# EasyEDA Pro project Foc驱动板.eprj, schematic Schematic2 (continued)
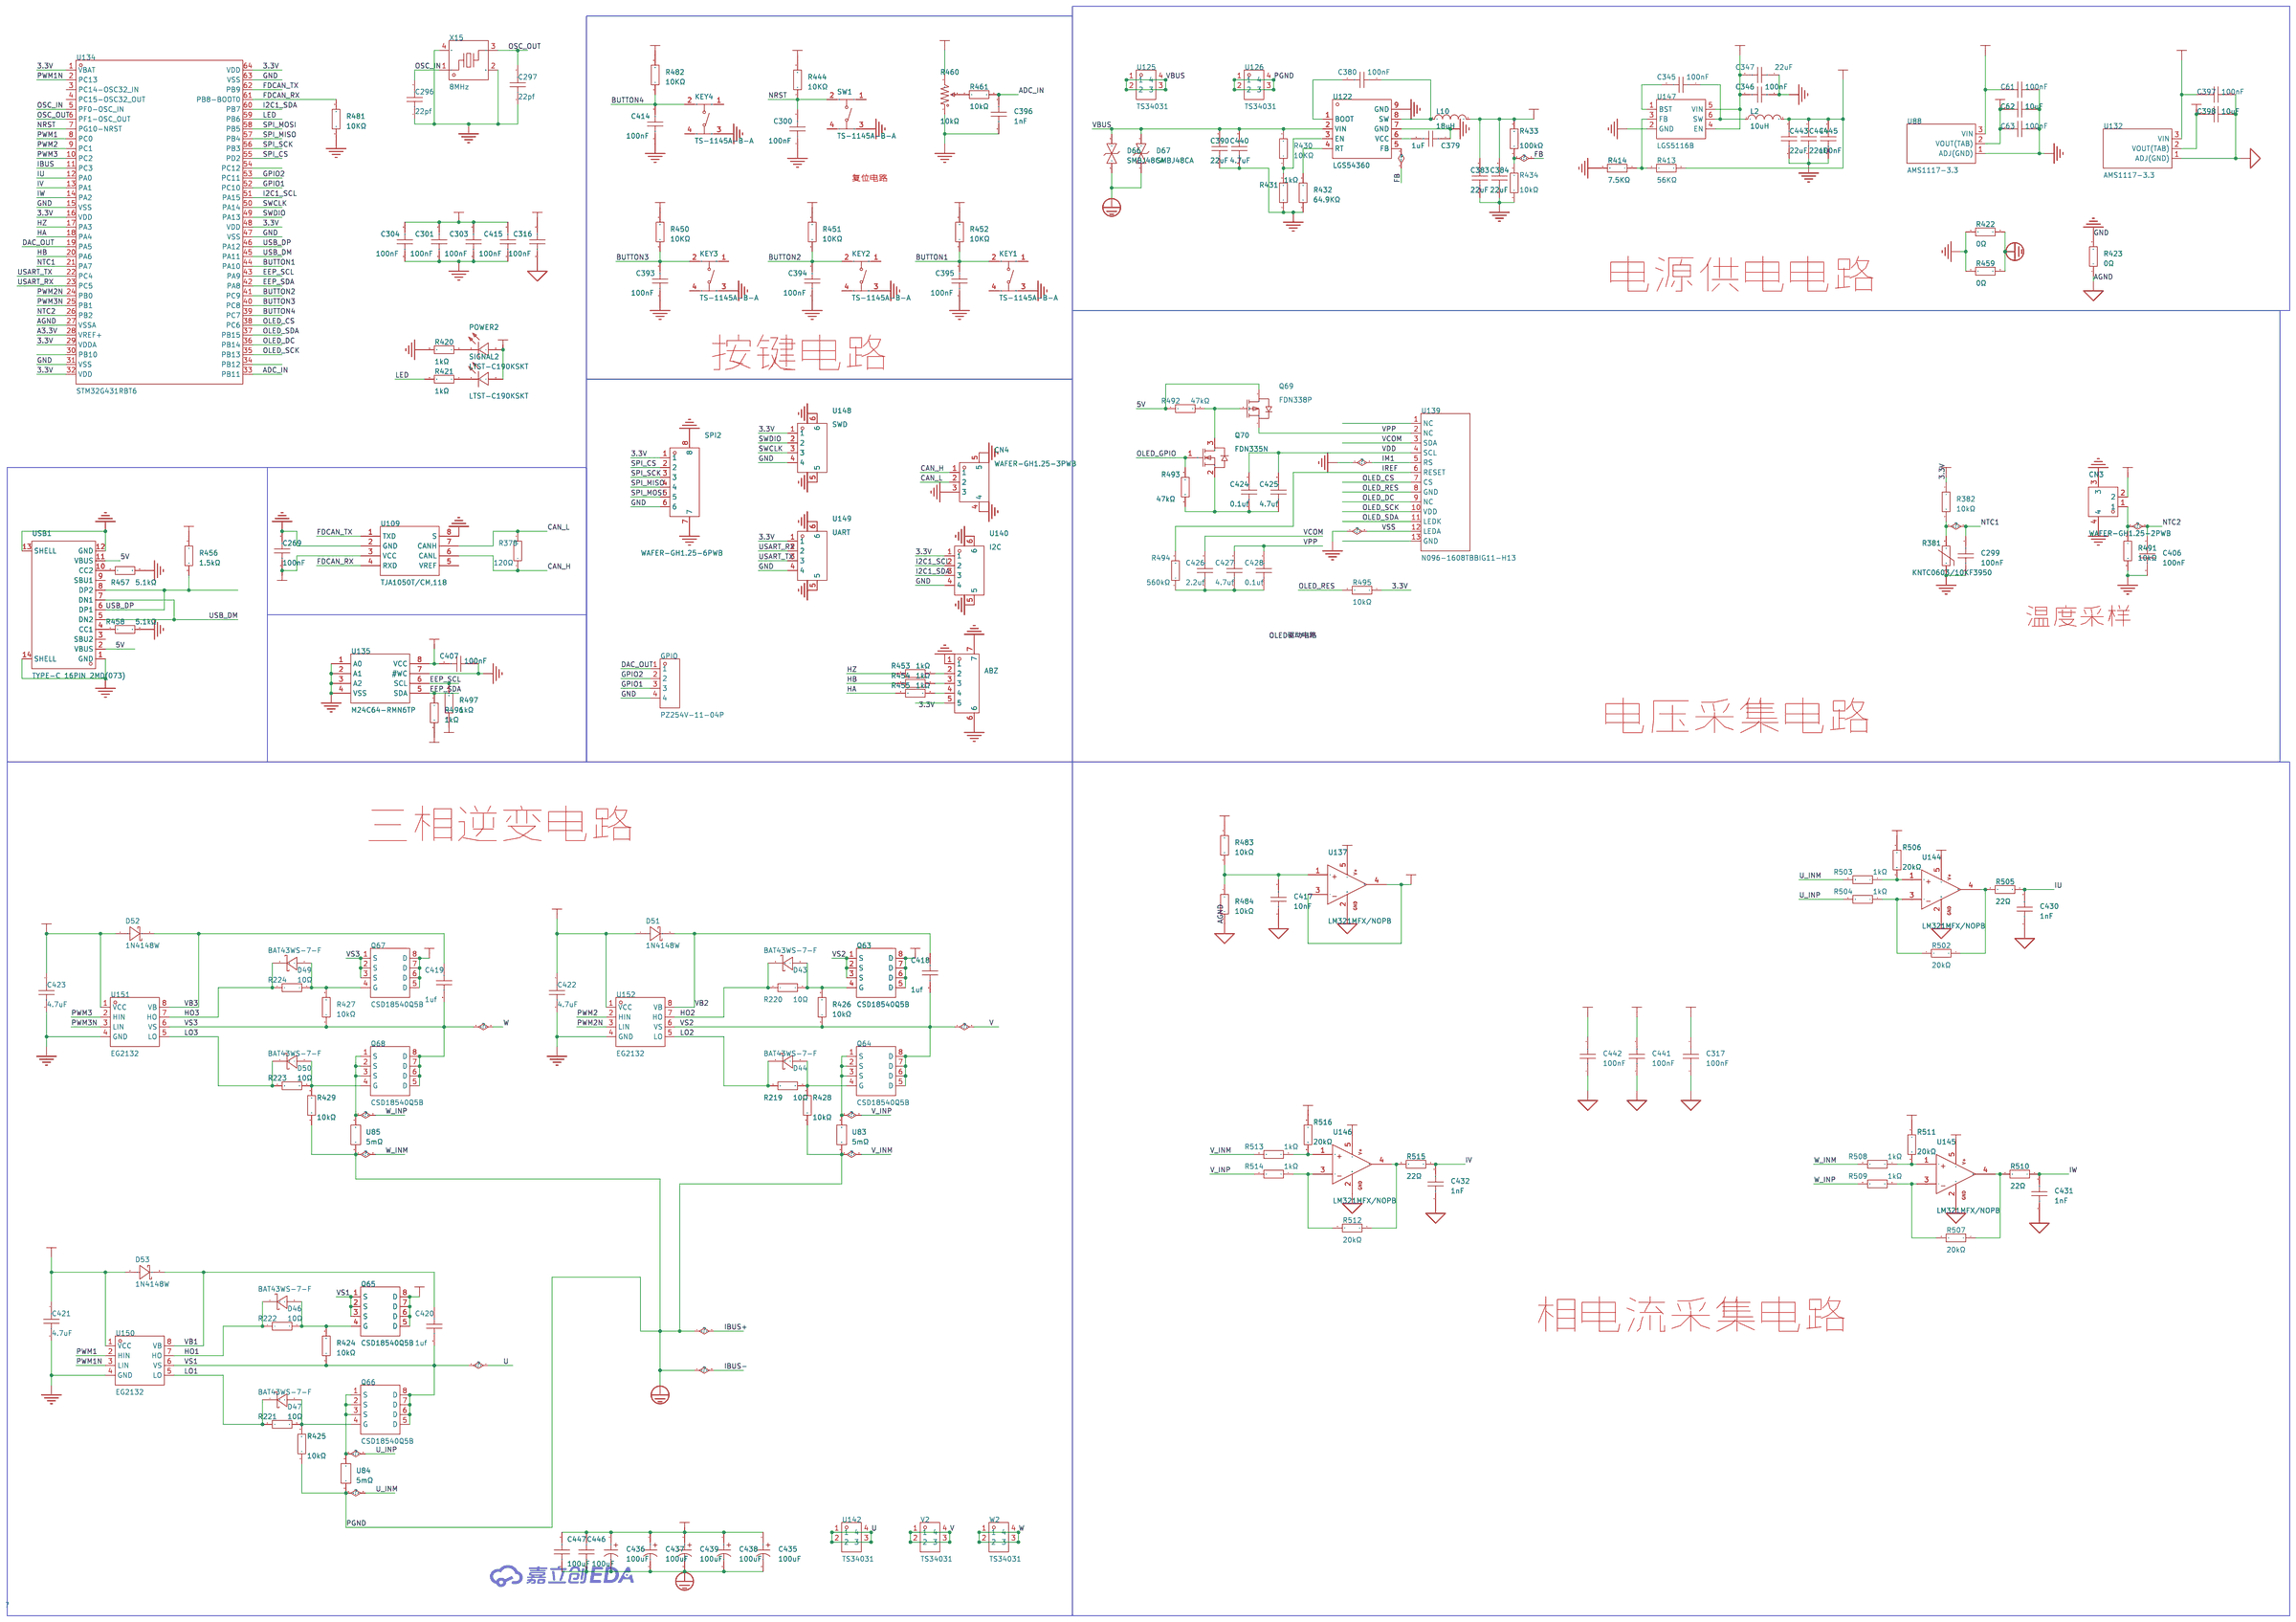
[diagram p0: schematic sheet]
## Parts
sheet MCU
C296  22pf  [C0603]
C297  22pf  [C0603]
C300  100nF  [C0603]
C301  100nF  [C0603]
C303  100nF  [C0603]
C304  100nF  [C0603]
C316  100nF  [C0603]
C415  100nF  [C0603]
POWER2  LTST-C190KSKT  [LED0603-RD]
R420  1kΩ  [R0603]
R421  1kΩ  [R0603]
R444  10KΩ  [R0603]
R481  10KΩ  [R0603]
SIGNAL2  LTST-C190KSKT  [LED0603-RD]
SW1  TS-1145A-B-A  [SW-SMD_4P-L4.2-W3.2-P2.15-LS5.2]
U134  STM32G431RBT6  [LQFP-64_L10.0-W10.0-P0.50-LS12.0-BL]
X15  8MHz  [CRYSTAL-SMD_4P-L3.2-W2.5-BL]
sheet 外设及接口电路
C269  100nF  [C0603]
C393  100nF  [C0603]
C394  100nF  [C0603]
C395  100nF  [C0603]
C396  1nF  [C0603]
C407  100nF  [C0603]
C414  100nF  [C0603]
CN5  WAFER-GH1.25-3PLB  [CONN-SMD_3P-P1.25_XUNPU_WAFER-GH1.25-3PLB]
GPIO1  PZ254V-11-04P  [HDR-TH_4P-P2.54-V-M]
KEY1  TS-1145A-B-A  [SW-SMD_4P-L4.2-W3.2-P2.15-LS5.2]
KEY2  TS-1145A-B-A  [SW-SMD_4P-L4.2-W3.2-P2.15-LS5.2]
KEY3  TS-1145A-B-A  [SW-SMD_4P-L4.2-W3.2-P2.15-LS5.2]
KEY4  TS-1145A-B-A  [SW-SMD_4P-L4.2-W3.2-P2.15-LS5.2]
R378  120Ω  [R0603]
R450  10KΩ  [R0603]
R451  10KΩ  [R0603]
R452  10KΩ  [R0603]
R453  1kΩ  [R0603]
R454  1kΩ  [R0603]
R455  1kΩ  [R0603]
R456  1.5kΩ  [R0603]
R457  5.1kΩ  [R0603]
R458  5.1kΩ  [R0603]
R460  10kΩ  [RES-ADJ-TH_3P-L9.5-W9.5-P2.54-BR-BS]
R461  10kΩ  [R0603]
R482  10KΩ  [R0603]
R496  1kΩ  [R0603]
R497  1kΩ  [R0603]
U109  TJA1050T/CM,118  [SOIC-8_L5.0-W4.0-P1.27-LS6.0-BL]
U135  M24C64-RMN6TP  [SOIC-8_L5.0-W4.0-P1.27-LS6.0-BL]
U159  WAFER-GH1.25-4PLB  [CONN-SMD_4P-P1.25_XUNPU_WAFER-GH1.25-4PLB]
U160  WAFER-GH1.25-4PLB  [CONN-SMD_4P-P1.25_XUNPU_WAFER-GH1.25-4PLB]
U161  WAFER-GH1.25-5PLB  [CONN-SMD_5P-P1.25_XUNPU_WAFER-GH1.25-5PLB]
U162  WAFER-GH1.25-6PLB  [CONN-SMD_6P-P1.25_XUNPU_WAFER-GH1.25-6PLB]
USB1  TYPE-C 16PIN 2MD(073)  [USB-C-SMD_TYPE-C-6PIN-2MD-073]
sheet 电源电路
C61  100nF  [C0603]
C62  10uF  [C0603]
C63  100nF  [C0603]
C345  100nF  [C0603]
C346  100nF  [C0603]
C347  22uF  [C0603]
C379  1uF  [C0603]
C380  100nF  [C0603]
C383  22uF  [C0805]
C384  22uF  [C0805]
C397  100nF  [C0603]
C398  10uF  [C0603]
C440  4.7uF  [C0805]
C443  22uF  [C0603]
C444  22uF  [C0603]
C445  100nF  [C0603]
C458  22uF  [CAP-SMD_BD6.3-L6.6-W6.6-LS7.4-FD]
D66  SMBJ48CA  [SMB_L4.6-W3.6-LS5.4-BI]
D67  SMBJ48CA  [SMB_L4.6-W3.6-LS5.4-BI]
L2  10uH  [IND-SMD_L5.4-W5.2_FXL0530]
L10  18uH  [IND-SMD_L6.0-W6.0]
R413  56KΩ  [R0603]
R414  7.5KΩ  [R0603]
R422  0Ω  [R0805]
R423  0Ω  [R0805]
R430  10KΩ  [R0603]
R431  1kΩ  [R0603]
R432  64.9KΩ  [R0603]
R433  100kΩ  [R0603]
R434  9.09kΩ  [R0603]
U88  AMS1117-3.3  [SOT-89_L4.5-W2.5-P1.50-LS4.2-BR]
U122  LGS54360  [ESOP-8_L4.9-W3.9-P1.27-LS6.0-BL-EP]
U125  TS34031  [CONN-SMD_TS34031]
U126  TS34031  [CONN-SMD_TS34031]
U132  AMS1117-3.3  [SOT-89_L4.5-W2.5-P1.50-LS4.2-BR]
U147  LGS5116B  [SOT-23-6_L2.9-W1.6-P0.95-LS2.8-BR]
sheet 逆变电路
C435  100uF  [CAP-TH_BD8.0-P3.50-D0.5-FD]
C436  100uF  [CAP-TH_BD8.0-P3.50-D0.5-FD]
C437  100uF  [CAP-TH_BD8.0-P3.50-D0.5-FD]
C438  100uF  [CAP-TH_BD8.0-P3.50-D0.5-FD]
C439  100uF  [CAP-TH_BD8.0-P3.50-D0.5-FD]
C446  100uF  [C1210]
C447  100uF  [C1210]
C449  4.7uF  [C0805]
C450  4.7uF  [C0805]
C451  4.7uF  [C0805]
C452  1uF  [C0805]
C453  100nF  [C0805]
C454  1uF  [C0805]
C455  100nF  [C0805]
C456  1uF  [C0805]
C457  100nF  [C0805]
D43  BAT43WS-7-F  [SOD-323_L1.8-W1.3-LS2.5-RD]
D44  BAT43WS-7-F  [SOD-323_L1.8-W1.3-LS2.5-RD]
D46  BAT43WS-7-F  [SOD-323_L1.8-W1.3-LS2.5-RD]
D47  BAT43WS-7-F  [SOD-323_L1.8-W1.3-LS2.5-RD]
D49  BAT43WS-7-F  [SOD-323_L1.8-W1.3-LS2.5-RD]
D50  BAT43WS-7-F  [SOD-323_L1.8-W1.3-LS2.5-RD]
D51  1N4148W  [SOD-123_L2.7-W1.6-LS3.7-FD]
D52  1N4148W  [SOD-123_L2.7-W1.6-LS3.7-FD]
D53  1N4148W  [SOD-123_L2.7-W1.6-LS3.7-FD]
Q71  AGM4005LL  [TOLL-8_L10.4-W9.9-P1.20-LS11.7-BL]
Q72  AGM4005LL  [TOLL-8_L10.4-W9.9-P1.20-LS11.7-BL]
Q73  AGM4005LL  [TOLL-8_L10.4-W9.9-P1.20-LS11.7-BL]
Q74  AGM4005LL  [TOLL-8_L10.4-W9.9-P1.20-LS11.7-BL]
Q75  AGM4005LL  [TOLL-8_L10.4-W9.9-P1.20-LS11.7-BL]
Q76  AGM4005LL  [TOLL-8_L10.4-W9.9-P1.20-LS11.7-BL]
R219  10Ω  [R0603]
R220  10Ω  [R0603]
R221  10Ω  [R0603]
R222  10Ω  [R0603]
R223  10Ω  [R0603]
R224  10Ω  [R0603]
R424  10kΩ  [R0603]
R425  10kΩ  [R0603]
R426  10kΩ  [R0603]
R427  10kΩ  [R0603]
R428  10kΩ  [R0603]
R429  10kΩ  [R0603]
U83  5mΩ  [R2512]
U84  5mΩ  [R2512]
U85  5mΩ  [R2512]
U142  TS34031  [CONN-SMD_TS34031]
U150  EG2132  [SOP-8_L4.9-W3.9-P1.27-LS6.0-BL]
U151  EG2132  [SOP-8_L4.9-W3.9-P1.27-LS6.0-BL]
U152  EG2132  [SOP-8_L4.9-W3.9-P1.27-LS6.0-BL]
U156  5mΩ  [R2512]
U157  5mΩ  [R2512]
U158  5mΩ  [R2512]
V2  TS34031  [CONN-SMD_TS34031]
W2  TS34031  [CONN-SMD_TS34031]
sheet 采样电路
C299  100nF  [C0603]
C317  100nF  [C0603]
C406  100nF  [C0603]
C417  10nF  [C0603]
C430  1nF  [C0603]
C431  1nF  [C0603]
C432  1nF  [C0603]
C441  100nF  [C0603]
C442  100nF  [C0603]
C448  100nF  [C0603]
R381  KNTC0603/10KF3950  [R0603]
R382  10kΩ  [R0603]
R483  10kΩ  [R0603]
R484  10kΩ  [R0603]
R491  10kΩ  [R0603]
R502  20kΩ  [R0603]
R503  1kΩ  [R0603]
R504  1kΩ  [R0603]
R505  22Ω  [R0603]
R506  20kΩ  [R0603]
R507  20kΩ  [R0603]
R508  1kΩ  [R0603]
R509  1kΩ  [R0603]
R510  22Ω  [R0603]
R511  20kΩ  [R0603]
R512  20kΩ  [R0603]
R513  1kΩ  [R0603]
R514  1kΩ  [R0603]
R515  22Ω  [R0603]
R516  20kΩ  [R0603]
R518  10kΩ  [R0603]
R519  1kΩ  [R0603]
TP1  -  [Test-Point-0.5mm]
TP2  -  [Test-Point-0.5mm]
U137  LM321MFX/NOPB  [SOT-23-5_L3.0-W1.7-P0.95-LS2.8-BR]
U153  RS821XF  [SOT-23-5_L3.0-W1.7-P0.95-LS2.8-BR]
U154  RS821XF  [SOT-23-5_L3.0-W1.7-P0.95-LS2.8-BR]
U155  RS821XF  [SOT-23-5_L3.0-W1.7-P0.95-LS2.8-BR]

## Library data of the parts
C296 C297 C300 C301 C303 C304 C316 C393-C395 C407 C414 C415 = CC0603KRX7R9BB104: 容值:100nF;精度:±10%;额定电压:50V;材质(温度系数):X7R;; LCSC Part Name: 100nF ±10% 50V; Supplier Part: C14663; Manufacturer: YAGEO(国巨); Supplier Footprint: 0603; JLCPCB Part Class: 基础库; Datasheet: https://atta.szlcsc.com/upload/public/pdf/source/20180910/C282072_33301C7F631E79921B82A8DAC6BCC5B3.pdf; Supplier: LCSC; Tolerance: ±10%; Voltage Rated: 50V; Temperature Coefficient: X7R
POWER2 SIGNAL2 = LTST-C190KSKT: 发光颜色:黄色;正向电压(VF):2.1V;功率:75mW;正向电流:20mA;主波长:584.5nm~597nm;二极管配置:-;透镜颜色:无色透明透镜;色温:-;发光强度:104mcd;发光角度:130°;载带方式:-;工作温度:-30℃~+85℃;; LCSC Part Name: 黄灯; Supplier Part: C125095; Manufacturer: LITEON(光宝); Supplier Footprint: 0603; JLCPCB Part Class: Extended Part; Datasheet: https://atta.szlcsc.com/upload/public/pdf/source/20180129/C125095_15171881843821315881.pdf; Supplier: LCSC; Emitted Color: 黄色; Forward Voltage (VF): 2.1V; Power Dissipation: 75mW; Forward Current: 20mA; Dominant Wavelength: 584.5nm~597nm; Peak Wavelength: 588nm; Lens Color: 无色透明透镜; Luminous Intensity: 104mcd; Viewing Angle: 130°; Operating Temperature: -30℃~+85℃
R219-R224 R378 R413 R414 R420 R421 R424-R434 R444 R450-R458 R481 R482 R496 R497 = 0603WAF1000T5E: 电阻类型:厚膜电阻;阻值:100Ω;精度:±1%;功率:100mW;最大工作电压:75V;温度系数:±200ppm/℃;; LCSC Part Name: 100Ω ±1% 100mW 厚膜电阻; Supplier Part: C22775; Manufacturer: UNI-ROYAL(厚声); Supplier Footprint: 0603; JLCPCB Part Class: 基础库; Datasheet: https://atta.szlcsc.com/upload/public/pdf/source/20200306/C422600_1E6D84923E4A46A82E41ADD87F860B5C.pdf; Supplier: LCSC; Type: 厚膜电阻; Tolerance: ±1%; Power(Watts): 100mW; Overload Voltage (Max): 75V; Temperature Coefficient: ±200ppm/℃; Operating Temperature Range: -55℃~+155℃
KEY1-KEY4 SW1 = TS-1145A-B-A: 电路结构:单刀单掷;按钮形状:椭圆形按钮;作用力:160gf;安装方式:立贴;开关长度:4.2mm;开关宽度:3.2mm;开关高度:2.5mm;带支架:不带;触点电流:50mA;额定电压(DC):12V;绝缘电阻:-;带灯:无;机械寿命:10万次;; LCSC Part Name: 4.2*3.2*2.5mm 立贴 轻触开关; Supplier Part: C318904; Manufacturer: XKB Connectivity(中国星坤); Supplier Footprint: SMD; JLCPCB Part Class: 扩展库; Datasheet: https://atta.szlcsc.com/upload/public/pdf/source/20211011/FC00869C3CE33BCCD344D072F551E76B.pdf; Supplier: LCSC; Circuit: 单刀单掷; Actuator Style: 椭圆形按钮; Operating Force: 160gf; Mounting Style: 立贴; Switch Length: 4.2mm; Switch Width: 3.2mm; Switch Height: 2.5mm; Strike Gundam: 不带; Contact Current: 50mA; Voltage Rating (DC): 12V; Actuator/Cap Color: 白色; With Lamp: 无; Mechanical Life: 10万次; Operating Temperature: -30℃~+85℃
U134 = STM32G431RBT6: CPU内核:ARM-M系列;CPU最大主频:170MHz;应用领域:-;; LCSC Part Name: 带DSP和FPU的170MHz主流ARM Cortex-M4 MCU，具有128 KB Flash存储器、数学加速器和中等模拟电平集成; Supplier Part: C431633; Manufacturer: ST(意法半导体); Supplier Footprint: LQFP-64(10x10); JLCPCB Part Class: 扩展库; Datasheet: https://item.szlcsc.com/datasheet/STM32G431RBT6/428111.html; Supplier: LCSC; CPU Core: ARM-M系列; CPU Maximum Speed: 170MHz; Program Storage Size: 128KB; Number of I/O: 52; ADC (Bit): 12bit; DAC (Bit): 12bit; Voltage - Supply: 1.71V~3.6V
X15 = X32258MSB4SI: 晶振类型:贴片晶振;频率:8MHz;常温频差:±10ppm;负载电容:20pF;频率稳定度:±20ppm;; LCSC Part Name: 8MHz ±10ppm 20pF; Supplier Part: C2682774; Manufacturer: YXC(扬兴晶振); Supplier Footprint: SMD3225-4P; JLCPCB Part Class: 扩展库; Datasheet: https://atta.szlcsc.com/upload/public/pdf/source/20240329/19D5F850207469550BEB00D7DFEDBC7A.pdf; Supplier: LCSC; Type: 贴片晶振; Normal temperature Frequency Tolerance: ±10ppm; Load Capacitance: 20pF; Frequency Stability: ±20ppm; Operating Temperature: -40℃~+85℃
C269 = CGA0603X5R226M160JT: 容值:22uF;精度:±20%;额定电压:16V;材质(温度系数):X5R;; LCSC Part Name: 22uF ±20% 16V; Supplier Part: C6119868; Manufacturer: HRE(芯声); Supplier Footprint: 0603; JLCPCB Part Class: 扩展库; Supplier: LCSC; Tolerance: ±20%; Voltage Rated: 16V; Temperature Coefficient: X5R
C61-C63 C299 C317 C396-C398 C406 C417 C430-C432 C441 C442 C448 = CGA0603X7R104K500JT: 容值:100nF;精度:±10%;额定电压:50V;材质(温度系数):X7R;; LCSC Part Name: 100nF ±10% 50V; Supplier Part: C6119867; Manufacturer: HRE(芯声); Supplier Footprint: 0603; JLCPCB Part Class: 扩展库; Supplier: LCSC; Tolerance: ±10%; Voltage Rated: 50V; Temperature Coefficient: X7R
CN5 = WAFER-GH1.25-3PLB: LCSC Part Name: 1x3P 间距:1.25mm 立贴 系列:GH; Supplier Part: C3029369; Manufacturer: XUNPU(讯普); Supplier Footprint: SMD,P=1.25mm; JLCPCB Part Class: 扩展库; Datasheet: https://item.szlcsc.com/datasheet/WAFER-GH1.25-3PLB/3561381.html; Supplier: LCSC; Pins Structure: 1x3P; Pitch: 1.25mm; Mounting Type: 立贴; Reference Series: GH; Number of Pins: 3P; Number of Rows: 1; Number of PINs Per Row: 3; Current Rating: 1A; Contact Material: 黄铜; Contact Plating: 锡; Operating Temperature: -25℃~+85℃; Voltage Rating: 125V; Plastic Material: LCP; Supplementary Features: 辅助焊脚; Color: 米色; Z-Height of the Board: 4.2mm; X-Length of Bottom Edge on Board (Spacing Line): 7mm; Y-Width of Bottom Edge on Board: 4.95mm
GPIO1 = PZ254V-11-04P: 插针结构:1x4P;间距:2.54mm;行距:-;圆针/方针:方针;安装方式:直插;排数:单排;总PIN位数:4P;额定电流:3A;额定电压:250V;配合针长度:6mm;塑高:2.5mm;端接针长度:3mm;触头材质:-;工作温度:-40℃~+105℃;颜色:黑色;; LCSC Part Name: 1x4P 间距:2.54mm 方针 直插; Supplier Part: C2691448; Manufacturer: XFCN(兴飞); Supplier Footprint: 插件,P=2.54mm; JLCPCB Part Class: 扩展库; Datasheet: https://item.szlcsc.com/datasheet/PZ254V-11-04P/2801085.html; Supplier: LCSC; Pin Structure: 1x4P; Pitch: 2.54mm; Circluar Pins/Square Pins: 方针; Mounting Type: 直插; Number of Rows: 单排; Number of Pins: 4P; Current Rating: 3A; Voltage Rating (Max): 250V; Length of Mating Pin: 6mm; Insulation Height: 2.5mm; Length of End Connection Pin: 3mm; Operating Temperature: -40℃~+105℃; Color: 黑色
R460 = 3386P-1-102TLF: 阻值:1kΩ;精度:±10%;; LCSC Part Name: 1kΩ ±10%; Supplier Part: C116301; Manufacturer: BOURNS; Supplier Footprint: 插件-3P,9.5x9.5mm; JLCPCB Part Class: 扩展库; Datasheet: https://item.szlcsc.com/datasheet/3386P-1-102TLF/117554.html; Supplier: LCSC; Tolerance: ±10%
R382 R461 R483 R484 R491 R502-R516 R518 R519 = 0603WAF1002T5E: 电阻类型:厚膜电阻;阻值:10kΩ;精度:±1%;功率:100mW;最大工作电压:75V;温度系数:±100ppm/℃;; LCSC Part Name: 厚膜电阻 10kΩ ±1% 100mW; Supplier Part: C25804; Manufacturer: UNI-ROYAL(厚声); Supplier Footprint: 0603; JLCPCB Part Class: 基础库; Datasheet: https://atta.szlcsc.com/upload/public/pdf/source/20200306/C422600_1E6D84923E4A46A82E41ADD87F860B5C.pdf; Supplier: LCSC; Type: 厚膜电阻; Tolerance: ±1%; Power(Watts): 100mW; Overload Voltage (Max): 75V; Temperature Coefficient: ±100ppm/℃; Operating Temperature Range: -55℃~+155℃
U109 = TJA1050T/CM,118: 类型:-;; LCSC Part Name: 4.75V~5.25V; Supplier Part: C6952; Manufacturer: NXP(恩智浦); Supplier Footprint: SOP-8; JLCPCB Part Class: 扩展库; Datasheet: https://www.nxp.com/docs/en/data-sheet/TJA1050.pdf; Supplier: LCSC; Supply Voltage: 4.75V~5.25V; Supply Current: 50mA
U135 = M24C64-RMN6TP: 接口类型:I2C;存储容量:64Kbit;时钟频率(fc):1MHz;; LCSC Part Name: 64 Kbit串行I2C总线EEPROM; Supplier Part: C79988; Manufacturer: ST(意法半导体); Supplier Footprint: SOIC-8; JLCPCB Part Class: 扩展库; Datasheet: https://item.szlcsc.com/datasheet/M24C64-RMN6TP/81133.html; Supplier: LCSC; Interface: I2C; Memory Size: 64Kbit; Clock Frequency: 1MHz; Voltage - Supply: 1.8V~5.5V; Write Cycle Time(Tw): 5ms; Data Retention - TDR (Year): 200年; Write Cycle Endurance: 400万次; Operating Temperature: -40℃~+85℃
U159 U160 = WAFER-GH1.25-4PLB: LCSC Part Name: 1x4P 间距:1.25mm 立贴 系列:GH; Supplier Part: C3029370; Manufacturer: XUNPU(讯普); Supplier Footprint: SMD,P=1.25mm; JLCPCB Part Class: 扩展库; Datasheet: https://item.szlcsc.com/datasheet/WAFER-GH1.25-4PLB/3561382.html; Supplier: LCSC; Pins Structure: 1x4P; Pitch: 1.25mm; Mounting Type: 立贴; Reference Series: GH; Number of Pins: 4P; Number of Rows: 1; Number of PINs Per Row: 4; Current Rating: 1A; Contact Material: 黄铜; Contact Plating: 锡; Operating Temperature: -25℃~+85℃; Voltage Rating: 125V; Plastic Material: LCP; Supplementary Features: 辅助焊脚; Color: 米色; Z-Height of the Board: 4.2mm; X-Length of Bottom Edge on Board (Spacing Line): 8.25mm; Y-Width of Bottom Edge on Board: 4.95mm
U161 = WAFER-GH1.25-5PLB: LCSC Part Name: 1x5P 间距:1.25mm 立贴 系列:GH; Supplier Part: C3029371; Manufacturer: XUNPU(讯普); Supplier Footprint: SMD,P=1.25mm; JLCPCB Part Class: 扩展库; Datasheet: https://item.szlcsc.com/datasheet/WAFER-GH1.25-5PLB/3561383.html; Supplier: LCSC; Pins Structure: 1x5P; Pitch: 1.25mm; Mounting Type: 立贴; Reference Series: GH; Number of Pins: 5P; Number of Rows: 1; Number of PINs Per Row: 5; Current Rating: 1A; Contact Material: 黄铜; Contact Plating: 锡; Operating Temperature: -25℃~+85℃; Voltage Rating: 125V; Plastic Material: LCP; Supplementary Features: 辅助焊脚; Color: 米色; Z-Height of the Board: 4.2mm; X-Length of Bottom Edge on Board (Spacing Line): 9.5mm; Y-Width of Bottom Edge on Board: 4.95mm
U162 = WAFER-GH1.25-6PLB: LCSC Part Name: 1x6P 间距:1.25mm 立贴 系列:GH; Supplier Part: C3029372; Manufacturer: XUNPU(讯普); Supplier Footprint: SMD,P=1.25mm; JLCPCB Part Class: 扩展库; Datasheet: https://item.szlcsc.com/datasheet/WAFER-GH1.25-6PLB/3561384.html; Supplier: LCSC; Pins Structure: 1x6P; Pitch: 1.25mm; Mounting Type: 立贴; Reference Series: GH; Number of Pins: 6P; Number of Rows: 1; Number of PINs Per Row: 6; Current Rating: 1A; Contact Material: 黄铜; Contact Plating: 锡; Operating Temperature: -25℃~+85℃; Voltage Rating: 125V; Plastic Material: LCP; Supplementary Features: 辅助焊脚; Color: 米色; Z-Height of the Board: 4.2mm; X-Length of Bottom Edge on Board (Spacing Line): 10.75mm; Y-Width of Bottom Edge on Board: 4.95mm
USB1 = TYPE-C 16PIN 2MD(073): 连接器类型:Type-C;协议标准:USB 3.1;公母:母;安装方式:卧贴;触点数量:16P;端口数量:1;额定电流 - 电源:3A;工作温度:-25℃~+85℃;; LCSC Part Name: Type-C 母 卧贴; Supplier Part: C2765186; Manufacturer: SHOU HAN(首韩); Supplier Footprint: SMD; JLCPCB Part Class: 扩展库; Datasheet: https://atta.szlcsc.com/upload/public/pdf/source/20250506/FFB74EDFDFA0AC372CE4A8E4F739CCEF.pdf; Supplier: LCSC; Connector Type: Type-C; Protocol Standard: USB 3.1; Gender: 母; Mounting Type: 卧贴; Number of Contacts: 16P; Number of Ports: 1; Current Rating-Power: 3A; Voltage Rating: 5V; Connect-Disconnect Life: 5千次; Detection color: 黑色; Operating Temperature: -25℃~+85℃
C345-C347 C379 C380 C443-C445 = CC0603KRX7R9BB474: 容值:470nF;精度:±10%;额定电压:50V;材质(温度系数):X7R;; LCSC Part Name: 470nF ±10% 50V; Supplier Part: C513577; Manufacturer: YAGEO(国巨); Supplier Footprint: 0603; JLCPCB Part Class: 扩展库; Datasheet: https://atta.szlcsc.com/upload/public/pdf/source/20200423/C519417_FF9998E3F66D767819CD86A66B468321.pdf; Supplier: LCSC; Tolerance: ±10%; Voltage Rated: 50V; Temperature Coefficient: X7R
C383 C384 C440 = CGA0805X5R226M350MT: 容值:22uF;精度:±20%;额定电压:35V;材质(温度系数):X5R;; LCSC Part Name: 22uF ±20% 35V; Supplier Part: C6119901; Manufacturer: HRE(芯声); Supplier Footprint: 0805; JLCPCB Part Class: 扩展库; Datasheet: https://atta.szlcsc.com/upload/public/pdf/source/20231129/D589D0CC4D260F7AC3A77E53B455CCB3.pdf; Supplier: LCSC; Tolerance: ±20%; Voltage Rated: 35V; Temperature Coefficient: X5R
C458 = RT63V22M6X8: LCSC Part Name: 22uF ±20% 63V; Supplier Part: C48971013; Manufacturer: JIERR(捷而瑞); Supplier Footprint: SMD,D6.3xL7.7mm; JLCPCB Part Class: 扩展库; Datasheet: https://item.szlcsc.com/datasheet/RT63V22M6X8/51296218.html; Supplier: LCSC; Tolerance: ±20%; Voltage Rating: 63V; Ripple Current: 49mA@120Hz; Diameter: 6.3mm; Height - Seated (Max): 7.7mm; Lifetime: 2000hrs@105℃; Operating Temperature: -40℃~+105℃
D66 D67 = SMBJ48CA_C19077591: LCSC Part Name: 双向TVS 48V截止 峰值浪涌电流：7.75A@10/1000us; Supplier Part: C19077591; Manufacturer: R+O(宏嘉诚); Supplier Footprint: DO-214AA(SMB); JLCPCB Part Class: 扩展库; Datasheet: https://item.szlcsc.com/datasheet/SMBJ48CA/20275676.html; Supplier: LCSC; Polarity: 双向; Reverse Stand-Off Voltage (Vrwm): 48V; Clamping Voltage: 77.4V; Peak Pulse Current (Ipp): 7.75A@10/1000us; Peak Pulse Power Dissipation (Ppp): 600W@10/1000us; Voltage - Breakdown: 58.9V; Reverse Leakage Current (Ir): 5uA; Number of Channels: 单路; Operating Temperature: -55℃~+150℃; level of protection: IEC 61000-4-2; Type: TVS
L2 = FXL0530-100-M: 电感值:10uH;精度:±20%;额定电流:3.2A;饱和电流(Isat):3.5A;类型:一体成型电感;; LCSC Part Name: 10uH ±20% 3.5A; Supplier Part: C177248; Manufacturer: cjiang(长江微电); Supplier Footprint: SMD,5.2x5.4mm; JLCPCB Part Class: 扩展库; Datasheet: https://atta.szlcsc.com/upload/public/pdf/source/20240426/3189EA8206330E2108542F9E34E540E7.pdf; Supplier: LCSC; Tolerance: ±20%; Rated Current: 3.2A; Saturation Current (Isat): 3.5A; DC Resistance (DCR): 125mΩ; Type: 一体成型电感
L10 = SMNR6045-180MT: 电感值:18uH;精度:±20%;额定电流:-;饱和电流(Isat):2.3A;类型:磁胶屏蔽电感;; LCSC Part Name: 18uH ±20% 2.3A; Supplier Part: C467143; Manufacturer: SXN(顺翔诺); Supplier Footprint: SMD,6x6mm; JLCPCB Part Class: 扩展库; Datasheet: https://atta.szlcsc.com/upload/public/pdf/source/20210810/8C07D4BA256EC9B57FF3FBBF0FDAC34D.pdf; Supplier: LCSC; Tolerance: ±20%; Current - Saturation(Isat): 2.3A; DC Resistance(DCR): 106mΩ; Type: 磁胶屏蔽电感
R422 R423 = 0805W8F0000T5E: 电阻类型:厚膜电阻;阻值:0Ω;精度:±1%;功率:125mW;最大工作电压:150V;温度系数:±800ppm/℃;; LCSC Part Name: 0Ω ±1% 125mW 厚膜电阻; Supplier Part: C17477; Manufacturer: UNI-ROYAL(厚声); Supplier Footprint: 0805; JLCPCB Part Class: 基础库; Datasheet: https://atta.szlcsc.com/upload/public/pdf/source/20200306/C422600_1E6D84923E4A46A82E41ADD87F860B5C.pdf; Supplier: LCSC; Type: 厚膜电阻; Tolerance: ±1%; Power(Watts): 125mW; Overload Voltage (Max): 150V; Temperature Coefficient: ±800ppm/℃; Operating Temperature Range: -55℃~+155℃
U88 U132 = AMS1117-3.3_C347256: 输出类型:固定;工作电压:18V;输出电压:3.3V;输出电流:1A;电源纹波抑制比(PSRR):60dB@(120Hz);输出极性:正极;; LCSC Part Name: 输出:3.3V 电流:1A 耐压:18V; Supplier Part: C347256; Manufacturer: UMW(友台半导体); Supplier Footprint: SOT-89; JLCPCB Part Class: 扩展库; Datasheet: https://atta.szlcsc.com/upload/public/pdf/source/20241218/BAF0263FA2E44BCD8AF41AA4FA04EFAA.pdf; Supplier: LCSC; Output Type: 固定; Voltage - Supply: 18V; Output Voltage: 3.3V; Output Current: 1A; Power Supply Rejection Ratio (PSRR): 60dB@(120Hz); Voltage Dropout: 1.3V@(1A); Features: 过流保护; Output Configuration: 正极; Number of Outputs: 1
U122 = LGS54360: 功能类型:降压型;输出类型:可调;工作电压:4.2V~65V;输出电流:3A;; LCSC Part Name: 4.2V-65V输入、3A宽输出范围、低纹波的同步降压转换器; Supplier Part: C20618070; Manufacturer: Legend-Si(棱晶半导体); Supplier Footprint: ESOP-8; JLCPCB Part Class: 扩展库; Datasheet: https://atta.szlcsc.com/upload/public/pdf/source/20240202/06A4A9AFD4E8DCA649D728EB1502243D.pdf; Supplier: LCSC; Function: 降压型; Output Type: 可调; Input Voltage: 4.2V~65V; Output Current: 3A; Switching Frequency: 200kHz~2MHz; Operating Temperature: -40℃~+125℃; Synchronous Rectification: 是; Number of Outputs: 1; Topology: 降压式; Quiescent Current (Iq): 70uA; Switch tube (built-in/external): 内置
U125 U126 U142 V2 W2 = TS34031: LCSC Part Name: 四脚 M3 二件套 TS34031; Supplier Part: C481441; Manufacturer: XFCN(兴飞); Supplier Footprint: SMD; JLCPCB Part Class: 扩展库; Datasheet: https://atta.szlcsc.com/upload/public/pdf/source/20240702/F73D6C2A31E01780573F167639CEBCF1.pdf; Supplier: LCSC
U147 = LGS5116B: 功能类型:降压型;输出类型:可调;工作电压:4.5V~18V;输出电压:600mV~12V;输出电流:2A;; LCSC Part Name: 18V2A高效同步降压转换器; Supplier Part: C5818961; Manufacturer: Legend-Si(棱晶半导体); Supplier Footprint: SOT23-6; JLCPCB Part Class: 扩展库; Datasheet: https://atta.szlcsc.com/upload/public/pdf/source/20230512/E333B4D1849F2BD1668D55CA883123F4.pdf; Supplier: LCSC; Function: 降压型; Output Type: 可调; Voltage - Supply: 4.5V~18V; Output Voltage: 600mV~12V; Output Current: 2A; Frequency - Switching: 500kHz; Operating Temperature: -40℃~+125℃; Synchronous Rectifier: 是; Number of Outputs: 1; Topology: 降压式; Quiescent Current: 400uA; Switch tube (built-in/external): 内置
C435-C439 = ERG50V100M8X12: 容值:100uF;精度:±20%;额定电压:50V;纹波电流:680mA@100kHz;等效串联电阻(ESR):120mΩ@100kHz;; LCSC Part Name: 100uF ±20% 50V; Supplier Part: C47344183; Manufacturer: JIERR(捷而瑞); Supplier Footprint: 插件,D8xL12mm; JLCPCB Part Class: 扩展库; Datasheet: https://item.szlcsc.com/datasheet/ERG50V100M8X12/49556624.html; Supplier: LCSC; Tolerance: ±20%; Voltage Rating: 50V; Ripple Current: 680mA@100kHz; Equivalent Series Resistance(ESR): 120mΩ@100kHz; Pin Spacing: 3.5mm; Diameter: 8mm; Height - Seated (Max): 12mm; Lifetime: 2000hrs@105℃; Operating Temperature: -40℃~+105℃
C446 C447 = CL32B106KBJNNNE: LCSC Part Name: 10uF ±10% 50V; Supplier Part: C138687; Manufacturer: SAMSUNG(三星); Supplier Footprint: 1210; JLCPCB Part Class: 扩展库; Datasheet: https://item.szlcsc.com/datasheet/CL32B106KBJNNNE/150006.html; Supplier: LCSC; Tolerance: ±10%; Voltage Rating: 50V; Temperature Coefficient: X7R
C449-C457 = CGA0805X5R476M100MT: LCSC Part Name: 47uF ±20% 10V; Supplier Part: C6119904; Manufacturer: HRE(芯声); Supplier Footprint: 0805; JLCPCB Part Class: 扩展库; Datasheet: https://item.szlcsc.com/datasheet/CGA0805X5R476M100MT/7062610.html; Supplier: LCSC; Tolerance: ±20%; Voltage Rating: 10V; Temperature Coefficient: X5R
D43 D44 D46 D47 D49 D50 = BAT43WS-7-F: 正向压降(Vf):1V@0.2A;直流反向耐压(Vr):30V;整流电流:200mA;; LCSC Part Name: 电压:30V 电流:200mA; Supplier Part: C134399; Manufacturer: DIODES(美台); Supplier Footprint: SOD-323; JLCPCB Part Class: 扩展库; Datasheet: https://atta.szlcsc.com/upload/public/pdf/source/20171023/C134399_15087453364591052494.pdf; Supplier: LCSC; Forward Voltage (Vf@If): 1V@0.2A; Reverse Voltage (Vr): 30V; Rectified Current: 200mA; Reverse Leakage Current (Ir): 500nA@25V
D51-D53 = 1N4148W_C7420318: 二极管配置:独立式;正向压降(Vf):1.25V@150mA;直流反向耐压(Vr):100V;平均整流电流(Io):150mA;功率:400mW;反向恢复时间(trr):4ns;; LCSC Part Name: 电压:100V 电流:150mA; Supplier Part: C7420318; Manufacturer: 宏迦橙; Supplier Footprint: SOD-123; JLCPCB Part Class: 扩展库; Datasheet: https://atta.szlcsc.com/upload/public/pdf/source/20230828/E5C3F7A4272052930A7E03B75759BF50.pdf; Supplier: LCSC; Diode Configuration: 独立式; Forward Voltage (Vf@If): 1.25V@150mA; Reverse Voltage (Vr): 100V; Average Rectified Current (Io): 150mA; Power Dissipation: 400mW; Reverse Leakage Current: 1uA@75V; Reverse Recovery Time (trr): 4ns; Operating Temperature: -55℃~+150℃
Q71-Q76 = AGM4005LL: LCSC Part Name: 1个N沟道 耐压:40V 电流:350A; Supplier Part: C5297497; Manufacturer: AGMSEMI(芯控源); Supplier Footprint: TOLL-8L; JLCPCB Part Class: 扩展库; Datasheet: https://item.szlcsc.com/datasheet/AGM4005LL/6044637.html; Supplier: LCSC; Number: 1个N沟道; Drain to Source Voltage: 40V; Current - Continuous Drain(Id): 350A; RDS(on): 0.82mΩ@10V; Pd - Power Dissipation: 300W; Gate Threshold Voltage (Vgs(th)): 1.7V@250uA; Gate Charge(Qg): 81nC@10V; Input Capacitance(Ciss): 5.44nF; Reverse Transfer Capacitance (Crss@Vds): 120pF; Operating Temperature: -55℃~+175℃; Output Capacitance(Coss): 1.815nF
U83-U85 U156-U158 = EBWM2512FL500S9: 电阻类型:采样电阻;阻值:0.5mΩ;精度:±1%;功率:6W;温度系数:±200ppm/℃;安装方式:贴片;; LCSC Part Name: 0.5mΩ ±1% 6W; Supplier Part: C7178835; Manufacturer: RESI(开步睿思）; Supplier Footprint: 2512; JLCPCB Part Class: 扩展库; Datasheet: https://atta.szlcsc.com/upload/public/pdf/source/20231123/32E1A2B1C6B1C8175FF8915A40EC1366.pdf; Supplier: LCSC; Type: 采样电阻; Tolerance: ±1%; Power(Watts): 6W; Temperature Coefficient: ±200ppm/℃; Mounting Sytle: 贴片
U150-U152 = EG2132: LCSC Part Name: 大功率MOS管、IGBT管栅极驱动芯片; Supplier Part: C480660; Manufacturer: EG(屹晶微); Supplier Footprint: SOP-8; JLCPCB Part Class: 扩展库; Datasheet: https://item.szlcsc.com/datasheet/EG2132/488583.html; Supplier: LCSC; Driven Configuration: 低边；高边; Load Type: MOSFET；IGBT; Number of Drivers: 2; Current - Output Low(IOL): 1.5A; Current - Output High(IOH): 1A; Voltage - Supply: 8V~20V; Rise Time: 180ns; Fall Time: 70ns; Features: 欠压保护(UVP); Operating Temperature: -45℃~+125℃; Input Logic Level - Low: -300mV~1V; Quiescent Current(Iq): 100uA
R381 = KNTC0603/10KF3950: 阻值:10kΩ;B值(25℃/50℃):3950K;功率:100mW;B值精度:±1%;最大稳态电流(25℃):310uA;; Supplier Part: C2892547; Manufacturer: KUU; Supplier Footprint: 0603; JLCPCB Part Class: 扩展库; Datasheet: https://atta.szlcsc.com/upload/public/pdf/source/20210908/154E92DD1F52D9B3804AA862EC2D5FAB.pdf; Supplier: LCSC; Resistance @ 25℃: 10kΩ; B Constant (25℃/50℃): 3950K; B Constant (25℃/85℃): 3987K; Power(Watts): 100mW; B Constant Tolerance: ±1%; Steady State Current (Max): 310uA; Operating Temperature: -40℃~+125℃
TP1 TP2 = Test-Point: Test Point 测试点
U137 = LM321MFX/NOPB: 放大器数:单路;轨到轨:-;增益带宽积(GBP):-;输入失调电压(Vos):7mV;压摆率(SR):400V/ms;输入偏置电流(Ib):500nA;; Supplier Part: C9405; Manufacturer: TI(德州仪器); Supplier Footprint: SOT-23-5; JLCPCB Part Class: 扩展库; Datasheet: http://www.ti.com/cn/lit/gpn/lm321; Supplier: LCSC; Number of Channels: 单路; Maximum Power Supply Range (Vdd-Vss): 32V; Vos - Input Offset Voltage: 7mV; Slew Rate: 400V/ms; Ib - Input Bias Current: 500nA; Noise density(eN): 40nV/√Hz@1kHz; Common Mode Rejection Ratio(CMRR): 85dB; Operating Temperature: -40℃~+85℃; Single supply: 3V~30V
U153-U155 = RS821XF: LCSC Part Name: 低噪声运放RS821XF; Supplier Part: C255441; Manufacturer: RUNIC(润石); Supplier Footprint: SOT-23-5; JLCPCB Part Class: 扩展库; Datasheet: https://atta.szlcsc.com/upload/public/pdf/source/20180801/C255445_305A33E98EF65BC5D144120E205E7EFA.pdf; Supplier: LCSC; Number of Channels: 单路; Maximum Power Supply Range (Vdd-Vss): 5.5V; Rail to Rail: 轨到轨输入,轨到轨输出; Gain Bandwidth Product: 14MHz; Vos - Input Offset Voltage: 2.5mV; Input Offset Voltage Drift(Vos TC): 1.6uV/℃; Slew Rate: 10V/us; Noise density(eN): 5.5nV/√Hz@10kHz; Common Mode Rejection Ratio(CMRR): 75dB; Operating Temperature: -40℃~+125℃

## Nets
3.3V: C62.1 C63.1 C301.2 C303.2 C304.2 C407.2 C415.2 POWER2.2(+) R382.1 R444.2 R450.2 R451.2 R452.2 R456.1 R460.3 R482.2 R496.2 R497.2 SIGNAL2.2(+) TP1.1 U88.2(VOUT(TAB)) U134.1(VBAT) U134.16(VDD) U134.29(VDDA) U134.32(VDD) U134.48(VDD) U134.64(VDD) U135.8(VCC) U159.1 U160.1 U161.5 U162.1
5V: C61.1 C269.1 C397.1 C443.1 C444.1 C445.1 L2.2 R413.1 U88.3(VIN) U109.3(VCC) U132.3(VIN) USB1.2(VBUS) USB1.11(VBUS)
12V: C346.1 C347.2 C383.2 C384.2 C452.2 C453.2 C454.2 C455.2 C456.2 C457.2 D51.1(A) D52.1(A) D53.1(A) L10.2 R433.2 U147.4(EN) U147.5(VIN) U150.1(VCC) U151.1(VCC) U152.1(VCC)
A3.3V: C316.2 C317.2 C398.1 C441.2 C442.2 R483.1 U132.2(VOUT(TAB)) U134.28(VREF+) U137.5(V+) U153.5(V+) U154.5(V+) U155.5(V+)
AGND: C316.1 C317.1 C397.2 C398.2 C417.1 C430.1 C431.1 C432.1 C441.1 C442.1 R423.1 R484.2 U132.1(ADJ(GND)) U134.27(VSSA) U137.2(GND) U153.2(V-) U154.2(V-) U155.2(V-)
GND: C61.2 C62.2 C63.2 C269.2 C296.1 C297.1 C299.1 C300.1 C301.1 C303.1 C304.1 C346.2 C347.1 C379.1 C383.1 C384.1 C393.1 C394.1 C395.1 C396.1 C406.1 C407.1 C414.1 C415.1 C440.1 C443.2 C444.2 C445.2 C448.1 C452.1 C453.1 C454.1 C455.1 C456.1 C457.1 C458.2 CN5.3 CN5.4 CN5.5 GPIO1.4 KEY1.3 KEY2.3 KEY3.3 KEY4.3 R381.1 R414.2 R420.2 R422.1 R423.2 R431.1 R432.1 R434.1 R457.2 R458.2 R460.1 R481.1 R491.2 R519.2 SW1.3 U88.1(ADJ(GND)) U109.2(GND) U109.8(S) U122.7(GND) U122.9(GND) U134.15(VSS) U134.31(VSS) U134.47(VSS) U134.63(VSS) U135.1(A0) U135.2(A1) U135.3(A2) U135.4(VSS) U135.7(#WC) U147.2(GND) U150.4(GND) U151.4(GND) U152.4(GND) U159.4 U159.5 U159.6 U160.4 U160.5 U160.6 U161.1 U161.6 U161.7 U162.6 U162.7 U162.8 USB1.1(GND) USB1.12(GND) USB1.13(SHELL) USB1.14(SHELL) X15.2(GND) X15.4(GND)
PGND: C435.2 C436.2 C437.2 C438.2 C439.2 C446.1 C447.1 D66.1 D67.1 R422.2 R425.1 R428.1 R429.1 R503.2 R508.2 R513.2 U83.1 U84.1 U85.1 U126.1 U126.2 U126.3 U126.4 U156.1 U157.1 U158.1
VBUS: C435.1 C436.1 C437.1 C438.1 C439.1 C440.2 C446.2 C447.2 C458.1 D66.2 D67.2 Q71.9(D) Q73.9(D) Q75.9(D) R430.2 R518.1 U122.2(VIN) U125.1 U125.2 U125.3 U125.4
ADC-: C406.2 R491.1 TP2.1 U134.36(PB14)
ADC_IN: C396.2 R461.2 U134.33(PB11)
BUTTON1: C395.2 KEY1.2 R452.1 U134.44(PA10)
BUTTON2: C394.2 KEY2.2 R451.1 U134.41(PC9)
BUTTON3: C393.2 KEY3.2 R450.1 U134.40(PC8)
BUTTON4: C414.2 KEY4.2 R482.1 U134.39(PC7)
CAN_H: CN5.1 R378.1 U109.6(CANL)
CAN_L: CN5.2 R378.2 U109.7(CANH)
DAC_OUT: GPIO1.1 U134.19(PA5)
EEP_SCL: R497.1 U134.43(PA9) U135.6(SCL)
EEP_SDA: R496.1 U134.42(PA8) U135.5(SDA)
FB: R433.1 R434.2 U122.5(FB)
FDCAN_RX: R481.2 U109.4(RXD) U134.61(PB8-BOOT0)
FDCAN_TX: U109.1(TXD) U134.62(PB9)
GPIO1: GPIO1.3 U134.52(PC10)
GPIO2: GPIO1.2 U134.53(PC11)
HA: R455.2 U134.18(PA4)
HB: R454.2 U134.20(PA6)
HO1: D46.1(C) R222.1 U150.7(HO)
HO2: D43.1(C) R220.1 U152.7(HO)
HO3: D49.1(C) R224.1 U151.7(HO)
HZ: R453.2 U134.17(PA3)
I2C1_SCL: U134.51(PA15)
I2C1_SDA: U134.60(PB7)
IU: C430.2 R505.1 U134.12(PA0)
IV: C432.2 R515.1 U134.13(PA1)
IW: C431.2 R510.1 U134.14(PA2)
LED: R421.2 U134.59(PB6)
LO1: D47.1(C) R221.1 U150.5(LO)
LO2: D44.1(C) R219.1 U152.5(LO)
LO3: D50.1(C) R223.1 U151.5(LO)
NRST: C300.2 R444.1 SW1.2 U134.7(PG10-NRST)
NTC1: C299.2 R381.2 R382.2 U134.34(PB12)
OLED_CS: U134.38(PC6)
OLED_DC: U134.54(PC12)
OLED_SCK: U134.35(PB13)
OLED_SDA: U134.37(PB15)
OSC_IN: C296.2 U134.5(PF0-OSC_IN) X15.1
OSC_OUT: C297.2 U134.6(PF1-OSC_OUT) X15.3
PWM1: U134.8(PC0) U150.2(HIN)
PWM1N: U134.2(PC13) U150.3(LIN)
PWM2: U134.9(PC1) U152.2(HIN)
PWM2N: U134.24(PB0) U152.3(LIN)
PWM3: U134.10(PC2) U151.2(HIN)
PWM3N: U134.25(PB1) U151.3(LIN)
SPI_CS: U134.55(PD2) U162.2
SPI_MISO: U134.57(PB4) U162.4
SPI_MOSI: U134.58(PB5) U162.5
SPI_SCK: U134.56(PB3) U162.3
SWCLK: U134.50(PA14) U160.3
SWDIO: U134.49(PA13) U160.2
U: C451.2 Q75.2(S) Q75.3(S) Q75.4(S) Q75.5(S) Q75.6(S) Q75.7(S) Q75.8(S) Q76.9(D) R424.1 U142.1 U142.2 U142.3 U142.4 U150.6(VS)
U_INP: Q76.2(S) Q76.3(S) Q76.4(S) Q76.5(S) Q76.6(S) Q76.7(S) Q76.8(S) R504.2 U84.2 U156.2
USART_RX: U134.23(PC5) U159.2
USART_TX: U134.22(PC4) U159.3
USB_DM: U134.45(PA11) USB1.5(DN2) USB1.7(DN1)
USB_DP: R456.2 U134.46(PA12) USB1.6(DP1) USB1.8(DP2)
V: C450.2 Q73.2(S) Q73.3(S) Q73.4(S) Q73.5(S) Q73.6(S) Q73.7(S) Q73.8(S) Q74.9(D) R426.1 U152.6(VS) V2.1 V2.2 V2.3 V2.4
V_INP: Q74.2(S) Q74.3(S) Q74.4(S) Q74.5(S) Q74.6(S) Q74.7(S) Q74.8(S) R514.2 U83.2 U158.2
VB1: C451.1 D53.2(K) U150.8(VB)
VB2: C450.1 D51.2(K) U152.8(VB)
VB3: C449.1 D52.2(K) U151.8(VB)
VOLT: C448.2 R518.2 R519.1 U134.11(PC3)
VREF: R506.1 R511.1 R516.1 U137.3(-) U137.4(OUT)
VS3: C449.2 Q71.2(S) Q71.3(S) Q71.4(S) Q71.5(S) Q71.6(S) Q71.7(S) Q71.8(S) Q72.9(D) R427.1 U151.6(VS) W2.1 W2.2 W2.3 W2.4
W_INP: Q72.2(S) Q72.3(S) Q72.4(S) Q72.5(S) Q72.6(S) Q72.7(S) Q72.8(S) R509.2 U85.2 U157.2
$1N9448: POWER2.1(-) R420.1
$1N9449: R421.1 SIGNAL2.1(-)
$2N2356: D46.2(A) Q75.1(G) R222.2 R424.2
$2N2357: D47.2(A) Q76.1(G) R221.2 R425.2
$2N2373: D43.2(A) Q73.1(G) R220.2 R426.2
$2N2381: D44.2(A) Q74.1(G) R219.2 R428.2
$2N2393: D50.2(A) Q72.1(G) R223.2 R429.2
$2N2394: D49.2(A) Q71.1(G) R224.2 R427.2
$3N1911: C417.2 R483.2 R484.1 U137.1(+)
$3N1915: R503.1 R506.2 U155.3(+IN)
$3N1932: R512.1 R515.2 U153.1(OUT)
$3N1942: R513.1 R516.2 U153.3(+IN)
$3N1943: R512.2 R514.1 U153.4(-IN)
$3N1949: R508.1 R511.2 U154.3(+IN)
$3N1950: R507.2 R509.1 U154.4(-IN)
$3N1953: R507.1 R510.2 U154.1(OUT)
$3N1954: R502.2 R504.1 U155.4(-IN)
$3N1957: R502.1 R505.2 U155.1(OUT)
$4N1693: C345.2 U147.1(BST)
$4N1696: C380.1 L10.1 U122.8(SW)
$4N1698: C379.2 U122.6(VCC)
$4N1708: R430.1 R431.2 U122.3(EN)
$4N1709: R432.2 U122.4(RT)
$4N1728: C380.2 U122.1(BOOT)
$4N1729: R413.2 R414.1 U147.3(FB)
$4N1731: C345.1 L2.1 U147.6(SW)
$5N1005: R460.2 R461.1
$5N1786: R453.1 U161.2
$5N1787: R454.1 U161.3
$5N1788: R455.1 U161.4
$5N3136: R457.1 USB1.10(CC2)
$5N3138: R458.1 USB1.4(CC1)

Not connected (* = marked no-connect by the designer): KEY1 1 4; KEY2 1 4; KEY3 1 4; KEY4 1 4; SW1 1 4; U109 5(VREF); U134 3(PC14-OSC32_IN) 4(PC15-OSC32_OUT) 21(PA7) 26(PB2) 30(PB10); USB1 3(SBU2) 9(SBU1)

## Notes on the sheets
sheet 1
- 复位电路
sheet 3
- 相电流采集电路
- 温度采样
sheet 4
- 电源供电电路
